# EasyEDA Pro project ProPrj_Avaota A1 八核 AIoT 开发板_2024-05-20.epro, board 点位_TOP (continued)
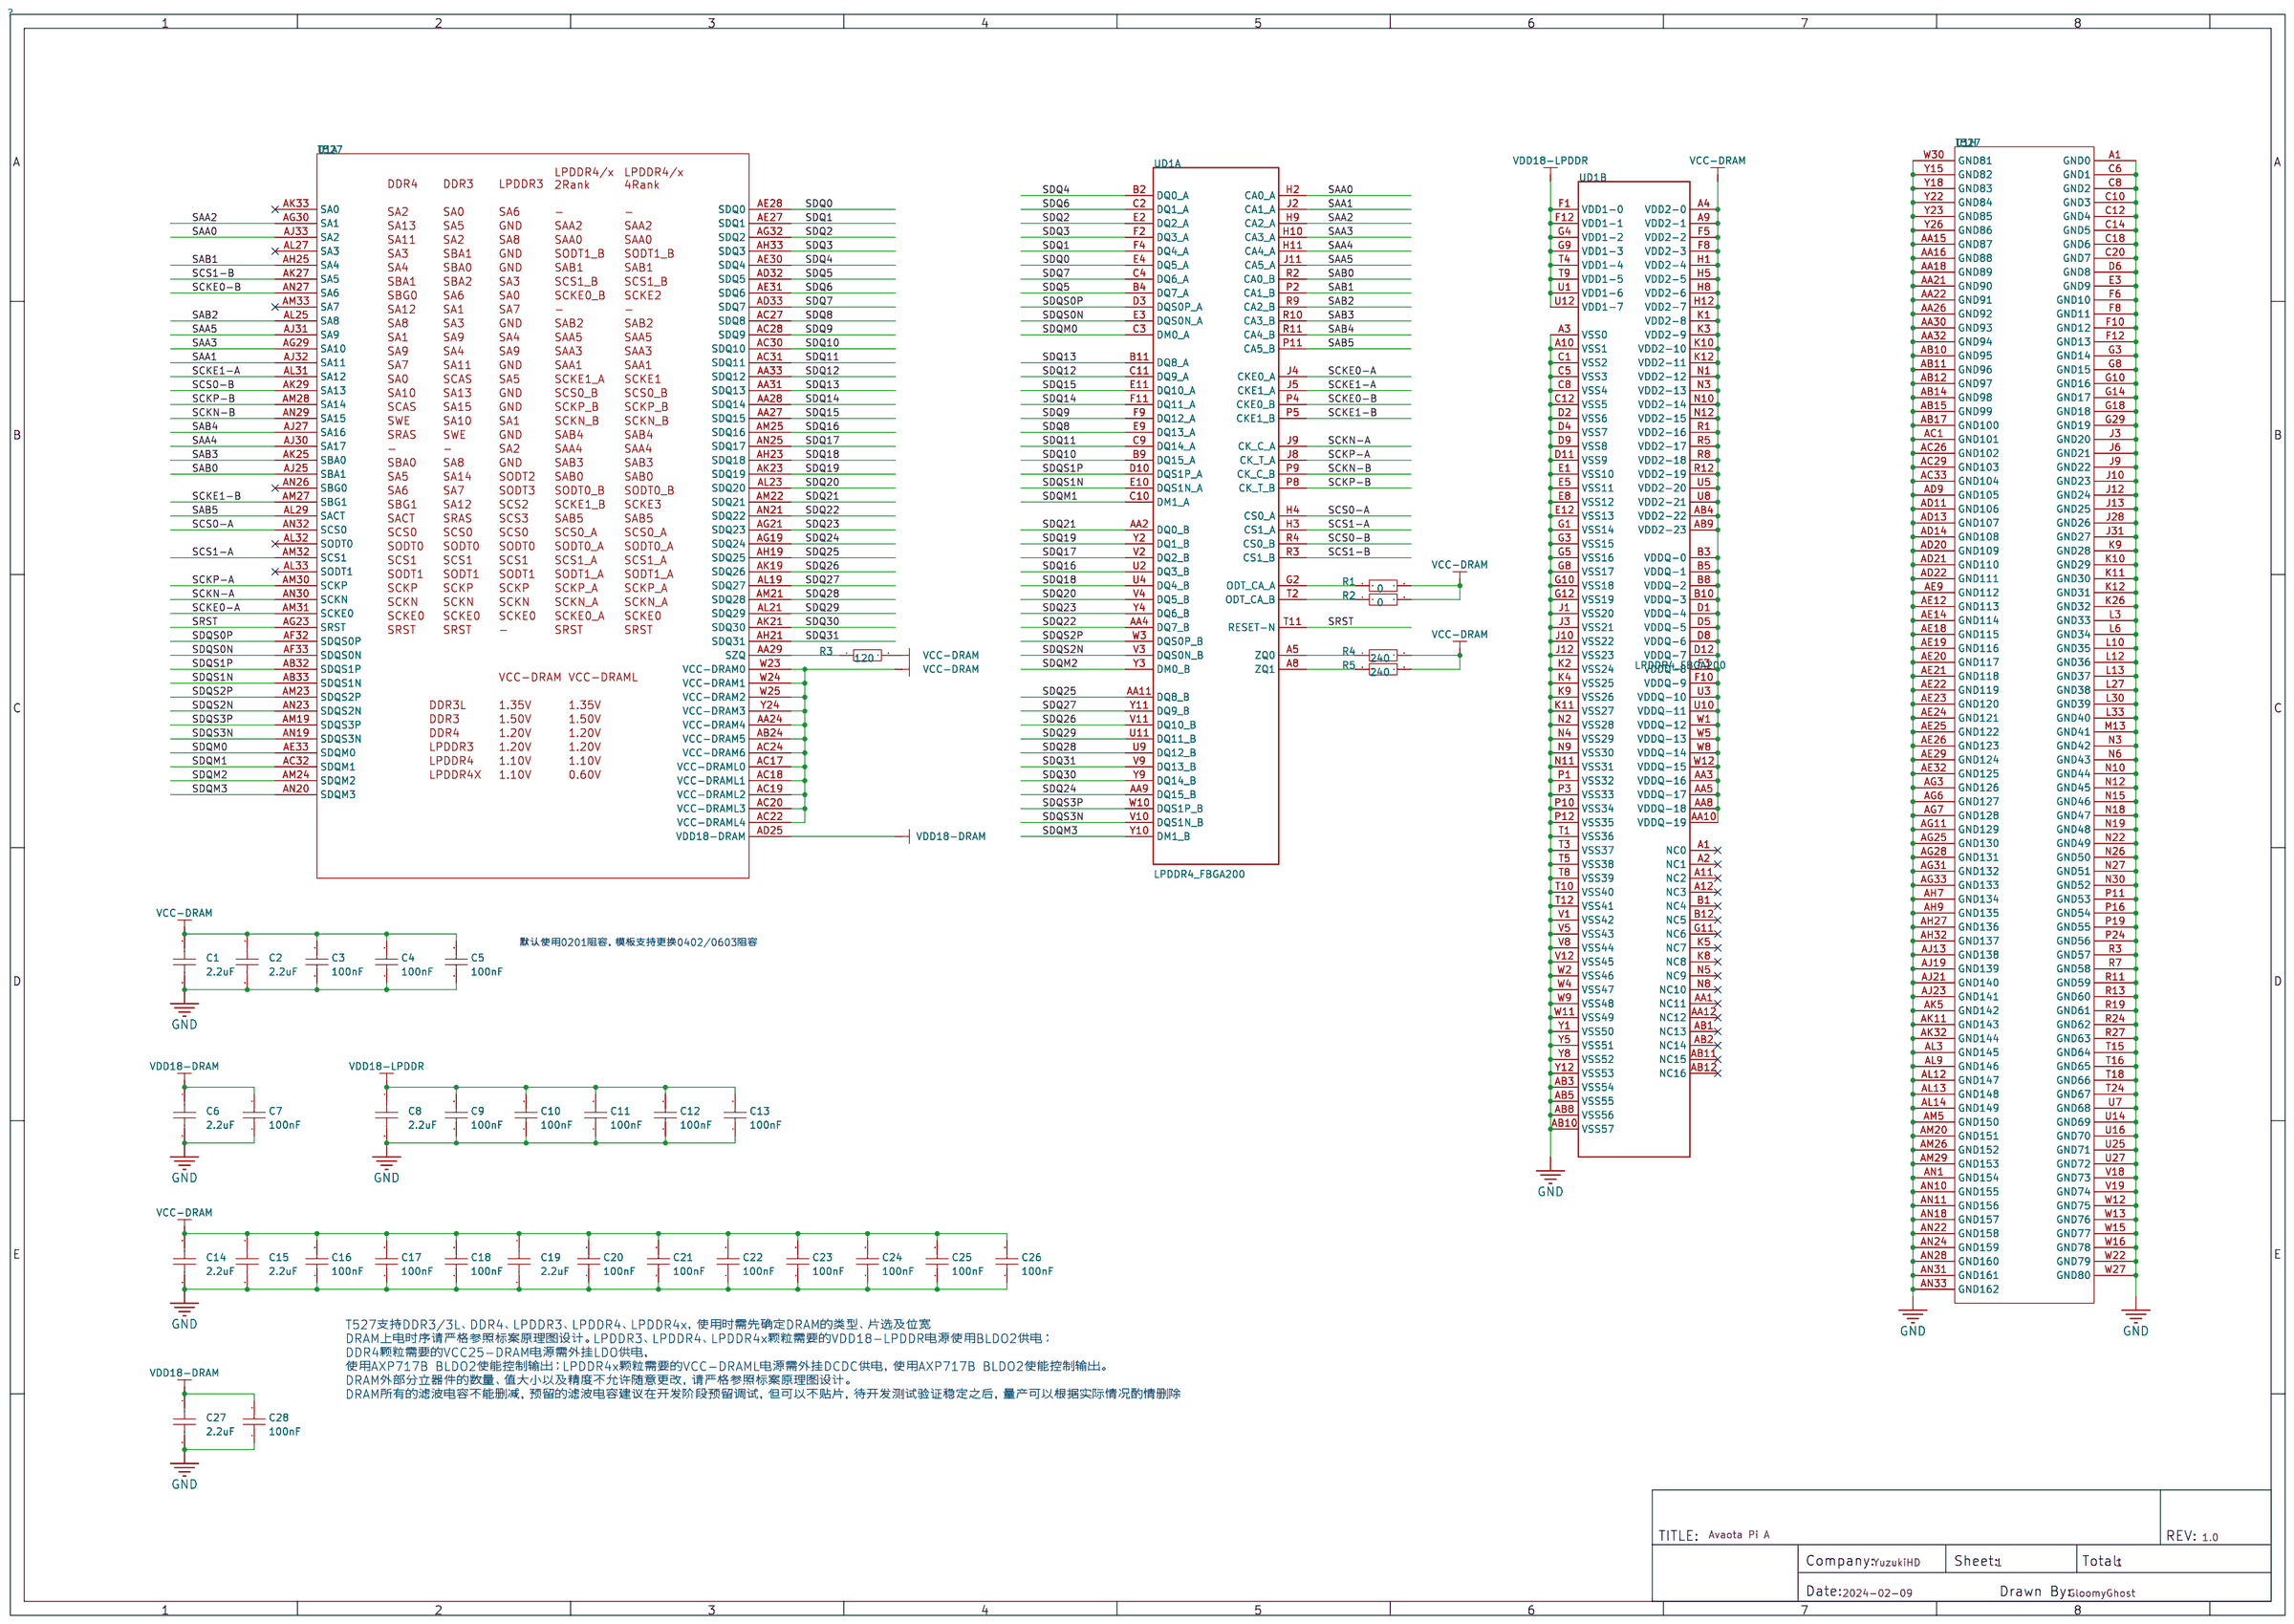
[diagram p0: schematic sheet]
## Nets (continued)
SDC2-RST: U8.K5 U14.Y31
SDQ0: U14.AE28 UD1.E4
SDQ1: U14.AE27 UD1.F4
SDQ2: U14.AG32 UD1.E2
SDQ3: U14.AH33 UD1.F2
SDQ4: U14.AE30 UD1.B2
SDQ5: U14.AD32 UD1.B4
SDQ6: U14.AE31 UD1.C2
SDQ7: U14.AD33 UD1.C4
SDQ8: U14.AC27 UD1.E9
SDQ9: U14.AC28 UD1.F9
SDQ10: U14.AC30 UD1.B9
SDQ11: U14.AC31 UD1.C9
SDQ12: U14.AA33 UD1.C11
SDQ13: U14.AA31 UD1.B11
SDQ14: U14.AA28 UD1.F11
SDQ15: U14.AA27 UD1.E11
SDQ16: U14.AM25 UD1.U2
SDQ17: U14.AN25 UD1.V2
SDQ18: U14.AH23 UD1.U4
SDQ19: U14.AK23 UD1.Y2
SDQ20: U14.AL23 UD1.V4
SDQ21: U14.AM22 UD1.AA2
SDQ22: U14.AN21 UD1.AA4
SDQ23: U14.AG21 UD1.Y4
SDQ24: U14.AG19 UD1.AA9
SDQ25: U14.AH19 UD1.AA11
SDQ26: U14.AK19 UD1.V11
SDQ27: U14.AL19 UD1.Y11
SDQ28: U14.AM21 UD1.U9
SDQ29: U14.AL21 UD1.U11
SDQ30: U14.AK21 UD1.Y9
SDQ31: U14.AH21 UD1.V9
SDQM0: U14.AE33 UD1.C3
SDQM1: U14.AC32 UD1.C10
SDQM2: U14.AM24 UD1.Y3
SDQM3: U14.AN20 UD1.Y10
SDQS0N: U14.AF33 UD1.E3
SDQS0P: U14.AF32 UD1.D3
SDQS1N: U14.AB33 UD1.E10
SDQS1P: U14.AB32 UD1.D10
SDQS2N: U14.AN23 UD1.V3
SDQS2P: U14.AM23 UD1.W3
SDQS3N: U14.AN19 UD1.V10
SDQS3P: U14.AM19 UD1.W10
SPI0-CLK: R123.1
SPI0-CS: U14.K3
SPI0-HOLD: U14.N2
SPI0-MISO: U14.L1
SPI0-MOSI: U14.L2
SPI0-WP: U14.M2
SPI-LCD-BLK: H1.32 U14.AN9
SPI-LCD-CLK: H1.36 TFT1.4 U14.AJ9
SPI-LCD-CS: H1.33 TFT1.7 U14.AK9
SPI-LCD-DC: H1.38 TFT1.5 U14.AJ7
SPI-LCD-MOSI: H1.35 TFT1.3 U14.AK7
SPI-LCD-RST: H1.31 TFT1.6 U14.AM9
SRST: U14.AG23 UD1.T11
STWI1-SCK: H1.28 U14.AM4
STWI1-SDA: H1.29 U14.AM3
UART1-CTS: U9.41 U14.U6
UART1-RTS: U9.44 U14.R4
UART1-RX: U9.42 U14.R5
UART1-TX: U9.43 U14.R6
USB0-DM: D26.2 U14.B24 USB3.A7 USB3.B7
USB0-DP: D25.2 U14.A24 USB3.A6 USB3.B6
USB0-DRVVBUS: R118.2 U14.AL17 U17.4
USB0-VBUSDET: R120.1 R121.2 U14.AK17
USB1-DM: D13.4 D13.7 U14.E24 USB2.2
USB1-DP: D13.5 D13.6 U14.D24 USB2.3
USB2-DM: D14.4 D14.7 U14.E22 USB2.11
USB2-DP: D14.5 D14.6 U14.D22 USB2.12
USB2-RXN: D15.1 D15.10 U14.C23 USB2.14
USB2-RXP: D15.2 D15.9 U14.B23 USB2.15
USB2-TXN: C219.1 U14.B22
USB2-TXP: C220.1 U14.A22
VCM-ADC: U14.Y9
VRA1: U14.AG5
VRA2: U14.AG4
VREFP-ADC: U14.AA9
VRP: U14.AC7
WL-REG-ON: U9.12 U14.U2
WL-WAKE-AP: U9.13 U14.U1
X32KIN: C100.2 R25.1 U14.AM12 X2.1
X32KOUT: C101.2 R25.2 U14.AM11 X2.2
$1N3706: L2.1 U4.10 U4.11
$1N3718: L3.1 U4.33
$1N3723: L4.1 U4.30
$1N3725: C43.1 U4.7
$1N4703: R13.2 U4.39
$1N4773: C44.2 U4.41 U4.42
$1N4806: R14.2 U4.38
$1N4992: L5.2 U4.45 U4.46
$1N6251: L6.1 U5.18
$1N6517: L7.1 U5.19
$1N6728: L8.1 U5.3
$1N7320: C88.1 U5.8
$1N42597: LED1.1 R17.1
$2N1846: R21.1 RESET1.3
$2N2360: R19.1 U14.V3
$2N2431: R20.1 U14.V2
$2N32401: FEL1.3 R22.1
$2N32457: PWR1.3 R23.1
$3N7591: U14.AA29
$3N7643: UD1.A5
$3N7644: UD1.A8
$3N7648: R36.1 UD1.G2
$3N7649: R37.1 UD1.T2
$4N500: R41.2 U14.Y32
$4N609: R42.1 U14.C19
$4N713: R43.1 U14.R1
$5N3909: R123.2 U14.K2
$6N1044: U14.G22
$6N1104: U14.G24
$6N1424: U14.F28
$6N1887: U14.G20
$6N1980: U14.E20
$6N3848: D7.2 R47.2
$6N3980: D8.1 D8.10 R48.2 USB1.13
$6N4130: D9.1 USB1.18
$6N4341: D8.2 D8.9 R50.2 R52.2 USB1.15
$6N4352: D8.4 D8.7 R51.2 R53.2 USB1.16
$6N4414: D8.5 D8.6 R54.2 USB1.19
$6N5317: C190.2 D10.1 D10.10 U15.1
$6N5400: C191.2 D10.2 D10.9 U15.3
$6N5519: C192.2 D10.4 D10.7 U15.4
$6N5561: C193.2 D10.5 D10.6 U15.6
$6N5603: C194.2 D11.1 D11.10 U15.7
$6N5645: C195.2 D11.2 D11.9 U15.9
$6N5687: C196.2 D11.4 D11.7 U15.10
$6N5729: C197.2 D11.5 D11.6 U15.12
$6N6451: C199.2 D12.2 D12.9 R61.2 U15.17
$6N6466: C198.2 D12.1 D12.10 R62.2 U15.15
$6N6553: U15.14
$6N6556: U15.13
$6N19248: C220.2 D15.5 D15.6 USB2.18
$6N19249: C219.2 D15.4 D15.7 USB2.17
$6N30377: R117.1 U17.3
$8N6741: LED2.1 LED3.3
$8N6795: LED3.1 LED4.3
$8N6805: LED4.1 LED5.3
$8N11462: TFT1.12
$10N1043: RJ1.P1
$10N3488: R79.2 RJ1.12
$10N3497: R80.1 RJ1.13
$11N1789: RJ2.P1
$11N1876: R97.2 RJ2.12
$11N1882: R98.1 RJ2.13
$12N612: D2.2 DC1.1 Q1.3
$12N673: Q1.1 R1.1 R2.2
$12N750: C3.2 DC1.5
$12N1163: C4.1 U3.1
$12N1491: C8.2 U3.4
$12N1559: C4.2 D4.2 L1.1 U3.8
$12N1618: C9.1 C10.1 U3.6
$12N1697: C9.2 R7.1
$12N1966: R3.1 R5.2
$12N2016: R5.1 R8.2 U3.5
$12N2052: R4.1 R6.2 U3.3
$12N3300: CN4.2 D1.1
$13N975: C245.2 R72.2 RF1.1
$13N1378: R77.1 R78.1
$13N1478: CN3.1 R77.2
$13N1485: CN3.2 R78.2
$13N5258: CGQ1.4 R125.1

Pads without a net: D12 5 6; D13 1 2 9 10; D14 1 2 9 10; DC1 4; FAN 1 2; FEL1 2 4; LED5 1; PWR1 2 4; RESET1 2 4; TFT1 1 2 9; U4 2 3 4 5 36 40; U5 10; U8 A1 A2 A7 A8 A9 A10 A11 A12 A13 A14 B1 B7 B8 B9 B10 B11 B12 B13 B14 C1 C3 C5 C7 C8 C9 C10 C11 C12 C13 C14 D1 D2 D3 D4 D12 D13 D14 E1 E2 E3 E5 E8 E9 E10 E12 E13 E14 F1 F2 F3 F10 F12 F13 F14 G1 G2 G3 G10 G12 G13 G14 H1 H2 H3 H12 H13 H14 J1 J2 J3 J12 J13 J14 K1 K2 K3 K6 K7 K10 K12 K13 K14 L1 L2 L3 L12 L13 L14 M1 M2 M3 M7 M8 M9 M10 M11 M12 M13 M14 N1 N3 N6 N7 N8 N9 N10 N11 N12 N13 N14 P1 P2 P7 P8 P9 P10 P11 P12 P13 P14; U9 4 5 8 10 11 21 23 24 25 26 27 28 29 30 32 35 37 38 39 40; U14 A5 A8 A16 AA1 AA2 AA3 AA4 AA5 AA6 AB2 AB3 AC2 AC3 AC4 AC5 AC6 AD1 AD2 AE1 AE2 AE4 AE5 AE6 AG1 AG2 AG13 AG17 AH1 AH2 AH11 AH13 AH15 AJ1 AJ15 AK1 AK13 AK15 AK33 AL5 AL7 AL11 AL15 AL27 AL32 AL33 AM6 AM7 AM8 AM14 AM15 AM16 AM17 AM18 AM33 AN4 AN7 AN8 AN15 AN17 AN26 B6 B7 B8 B9 B15 C7 C9 C15 F20 G4 G16 J2 M3 N1 N4 N5 N31 N32 N33 U28 U29 U30 U33 W4 W5 W6 W29 Y2 Y3; UD1 A1 A2 A11 A12 AA1 AA12 AB1 AB2 AB11 AB12 B1 B12 G11 K5 K8 N5 N8; USB2 5 6 8 9

## Via types
v1: diameter 0.399, hole 0.299, Top Layer to Bottom Layer, 335 vias
v2: diameter 0.4, hole 0.299, Top Layer to Bottom Layer, 496 vias
v3: diameter 0.4, hole 0.3, Top Layer to Bottom Layer, 279 vias
v4: diameter 0.61, hole 0.305, Top Layer to Bottom Layer, 5 vias

## Routing (per net, layer and track width the routed paths; a pad name or vN(x,y) marks a point on that pad's centre or on a via; arc(x,y) is an arc through that point)
AGND: length 3.5
  Top Layer w0.152: v2(57.92,55.15) U14.AE3
  Bottom Layer w0.152: 59.14,54.55 59.04,54.65 58.52,54.65 58.52,54.64 57.99,54.64 ; 59.14,54.55 59.14,53.92 ; 59.14,54.55 59.21,54.61 ; 57.99,54.64 57.99,55.08 v2(57.92,55.15) ; 57.99,54.64 57.99,54.08
GND: length 1105.6
  Top Layer w0.076: 52.98,41.81 53.25,41.81 53.33,41.89 53.33,41.89 53.68,41.89 53.93,42.14 ; 68.68,42.41 68.68,42.41 ; 68.68,42.41 68.69,42.16 68.68,41.88 U14.C30 ; 68.68,42.41 U14.C28 ; 68.68,42.41 68.68,42.41 ; v3(49.07,45.47) 49.43,45.8 50.57,45.8 v3(50.8,45.47) ; 56.61,39.42 56.7,39.42 57.18,39.91 57.18,40.28 57.43,40.54 57.43,40.64 ; 65.44,55.14 65.69,55.39 65.69,55.77 65.8,55.88 65.8,56.66 v2(65.94,56.79) ; v2(70.08,49.33) 69.97,49.21 69.22,49.21 69.04,49.39 68.67,49.39 68.45,49.61 ; 56.43,40.14 56.35,40.14 56.19,39.98 56.18,39.98 55.93,39.73 55.12,39.73 54.46,39.06 v3(54.46,39.01) ; 64.45,55.13 64.7,55.38 64.7,55.77 64.87,55.94 64.87,56.35 64.77,56.45 64.77,57.26 64.85,57.33 ; 56.43,40.28 56.68,40.53 56.68,40.89 56.43,41.14 ; U14.A32 69.31,40.65 69.06,40.89 68.69,40.89 U14.C31 ; 64.44,40.14 64.28,39.81 64.23,39.66 64.25,39.32 v2(64.08,38.86) ; 54.51,39.85 54.68,40.03 54.68,40.39 54.93,40.64 ; v1(73.53,53.47) 70.49,53.47 69.91,52.89 68.69,52.89 68.44,52.64 ; 52.55,51.2 52.45,51.3 52.45,51.77 52.65,51.97 52.96,51.97 53.28,51.65 U14.AN10 ; 68.44,43.64 68.69,43.4 69.05,43.4 69.2,43.25 arc(69.25,43.25) 69.29,43.24 arc(69.38,43.22) 69.47,43.22 arc(69.81,43.22) v2(70.16,43.18) ; v3(52.79,42.53) 52.74,42.53 52.73,42.54 51.66,42.54 51.59,42.47 48.99,42.47 46.4,45.06 46.4,45.29 43.86,47.84 43.69,47.82 40.1,47.82 ; 70.59,46.33 70.62,46.36 70.75,46.36 70.89,46.51 v2(71.09,46.51) ; 39.59,47.82 37.51,47.82 v3(37.06,48.41) ; 39.59,47.82 UD1.N4 ; 39.59,47.82 40.1,47.82 ; 69.92,43.23 69.9,43.25 ; v3(52.19,41.81) 52.07,41.68 48.72,41.68 45.64,44.75 45.64,45.06 43.54,47.16 36.65,47.16 36.63,47.18 36.33,47.18 v3(36.17,47.33) ; 36.91,36.04 36.91,35.62 U8.N2 ; UD1.N4 40.1,47.82 ; UD1.N4 v3(40.23,48.43) ; 68.44,47.64 68.69,47.39 69.05,47.39 69.22,47.23 69.84,47.23 70.03,47.41 v2(70.24,47.41) ; 68.69,51.39 69.64,51.39 69.82,51.58 ; 68.69,51.39 68.44,51.64 ; 68.69,51.39 68.69,51.39 68.69,50.89 U14.C12 ; 71.05,44.25 72.29,44.25 v1(72.31,44.22) ; 53.93,46.64 53.68,46.89 53.07,46.89 ; 62.2,57.01 62.2,56.85 v2(62.2,56.85) 62.23,56.37 62.2,56.13 62.2,56.07 62.21,55.9 62.19,55.7 62.19,55.42 62.43,55.18 ; 68.44,52.64 68.69,52.39 68.69,51.9 U14.C10 ; 68.44,52.64 U14.C8 ; v3(59.9,41.59) 59.69,41.28 59.68,40.93 59.44,40.65 ; 63.4,56.72 63.2,56.52 63.2,55.38 63.44,55.14 ; 53.01,43.39 53.68,43.39 53.93,43.64 ; 71.04,44.23 arc(70.87,44.22) 70.7,44.23 arc(70.67,44.24) 70.64,44.24 70.36,44.24 arc(70.22,44.24) 70.09,44.24 69.22,44.24 69.07,44.39 arc(69.04,44.39) 69,44.39 arc(68.72,44.46) 68.47,44.62
  Top Layer w0.102: 61.49,22.4 61.73,22.64 C252.1 62.67,22.64 v2(62.76,22.56) ; v3(48.36,47.8) 49.91,47.8 49.98,47.73 51.74,47.73 ; v2(66.95,55.14) 67.44,55.14 ; C101.1 51.23,55.16 51.23,54.22 51.26,54.2 51.54,54.2 52.04,53.69 52.04,51.48 52.32,51.2 52.55,51.2 52.65,51.1 53.4,51.1 U14.AN11 ; v2(44.75,19.63) 44.58,19.81 D6.8 D6.3 v2(44.58,21.79) ; 51.36,52.3 51.35,52.31 C100.1 ; 51.36,52.3 arc(51.36,51.77) 51.36,51.25 ; 51.36,52.3 arc(51.36,52.39) 51.36,52.48 arc(51.36,52.91) 51.36,53.34 ; R33.1 R35.1 v2(57.56,59.79) ; v3(56.07,39) 56.07,39.05 56.44,39.42 56.61,39.42 ; X1.4 50.53,51.02 C99.1 51.36,51.25 ; v3(52.91,44.78) 52.8,44.78 52.4,44.38 51.45,44.38 51.36,44.29 51.33,44.29 ; 66.95,55.15 U14.G3 ; 51.36,51.25 51.64,50.97 v2(51.64,50.72) ; R34.1 v2(59.23,59.82) ; v2(47.45,21.79) D5.3 ; v1(36.91,36.6) 36.91,36.04 ; 56.43,40.28 56.43,40.14 ; v2(47.45,19.76) D5.8
  Top Layer w0.115: v3(50.8,45.47) 50.8,45.44 51.2,45.03 52.07,45.03 52.63,45.59 53.38,45.59 ; 53.38,45.59 53.39,45.59 U14.AN22 ; 53.38,45.59 53.43,45.64
  Top Layer w0.127: 53.01,43.39 53,43.38 52.24,43.38 v3(52.09,43.23) ; 64.85,57.33 v2(64.99,57.47) ; 50.14,23.88 D12.3 v2(50.14,22.33) ; v2(51.46,24.56) 51.37,24.56 R60.1 51.22,24.8 ; v3(48.36,47.8) 48.33,47.8 48.16,47.62 48.16,46.86 48.49,46.53 48.94,46.53 49.06,46.65 v3(49.6,46.65) ; 35.81,33.63 35.23,34.21 35.23,35.87 v1(34.44,36.65) ; 35.81,33.63 35.81,34.03 U8.P4 ; 35.81,33.63 36.06,33.39 U8.P6 U8.N5 ; v3(36.23,50.43) 36.18,50.38 35.41,50.38 v3(35.38,50.42) ; 34.41,44.51 33.81,44.51 ; D15.8 D15.3 ; D13.8 D13.3 ; 41.41,46.15 41.71,46.46 43.13,46.46 44.88,44.7 44.88,44.48 48.46,40.89 52.74,40.89 ; v3(40.21,49.61) 40.11,49.71 39.35,49.71 ; v2(85.78,17.68) C272.2 ; 35.81,48.1 35.81,47.7 ; U14.C31 U14.C30 ; 52.98,41.81 52.27,41.81 52.26,41.81 v3(52.19,41.81) ; 33.92,49.72 34.58,49.72 v3(34.59,49.71) ; v2(65.58,17.7) C267.2 ; v2(83.79,17.68) C275.1 ; D8.3 D8.8 ; C266.2 v2(67.61,17.7) ; D11.8 D11.3 ; D10.8 D10.3
  Top Layer w0.152: C101.1 50.91,55.72 50.22,56.41 ; 78.33,48.95 79.07,48.21 81.59,48.21 81.79,48.41 81.79,48.9 81.59,49.1 v1(80.85,49.1) ; v3(53.34,39.03) 53.35,39.03 53.35,39.07 54.14,39.85 54.51,39.85 ; U5.9 14.52,42.61 14.25,42.34 13.97,42.34 13.72,42.6 13.72,44.2 13.98,44.46 C73.2 ; 76.25,7.14 v2(76.25,7.24) ; 76.25,7.14 R112.1 ; 76.25,7.14 76.25,7.12 R114.1 ; C35.1 14.01,55.07 C64.1 ; v1(78.33,23.01) 79.1,23.01 79.96,22.15 80.25,22.15 80.49,22.39 C259.1 ; U14.R13 62.83,49.76 63.56,49.76 U14.M13 ; U8.C4 41.29,34.01 41.1,34.01 40.82,34.29 40.07,34.29 U8.G5 ; C95.1 6.82,47.37 v2(7.29,47.37) ; C64.1 C66.1 ; C64.1 C12.2 C62.1 C60.1 C65.2 C63.2 C17.2 C61.2 C59.2 C54.2 C53.2 C55.2 C52.2 C51.2 v1(14.99,47.83) ; U14.Y22 U14.AA22 U14.AA21 ; U14.Y22 U14.Y23 ; U14.Y22 U14.W22 ; R104.1 R100.1 ; 35.28,41.94 35.15,41.91 v3(34.52,41.94) ; 56.87,42.22 U14.AE29 v3(57.91,42.42) ; 56.87,42.22 v3(56.94,41.66) U14.AG31 ; 56.87,42.22 U14.AG28 ; 8.47,47.41 8.46,47.42 ; 8.47,47.41 v2(8.47,47.04) ; 8.47,47.41 C43.2 ; U14.AN18 52.56,47.65 51.97,48.23 48.79,48.23 v3(48.36,47.8) ; v1(49.38,26.26) 48.92,26.26 48.56,25.91 R62.1 ; 60.43,41.64 59.96,41.64 v3(59.9,41.59) ; C258.2 C256.2 84.24,27.13 R111.1 R113.1 ; U14.AA7 59.43,53.14 v1(58.98,53.14) ; C69.2 17.7,41.15 v1(17.53,41.33) ; 53.41,41.12 53.16,41.12 ; TFT1.8 90.1,44.31 90.4,44.6 90.4,45.8 v1(90.02,46.18) ; U14.C20 U14.C21 U14.B21 69.64,46.15 69.82,46.33 70.59,46.33 ; v3(36.17,47.33) 35.81,47.7 ; U13.41 84.76,22.3 86.92,24.46 86.92,25.2 88.06,26.34 88.06,26.87 87.82,27.11 C274.2 ; U14.A33 69.61,40.15 v2(69.85,40.39) 69.59,40.65 U14.A32 ; U14.F12 66.88,50.65 66.42,51.11 v1(66.42,51.13) ; v3(49.07,45.47) 49.07,45.19 49.97,44.29 51.33,44.29 ; 53.07,46.89 52.86,46.89 52.58,46.61 52.04,46.61 51.76,46.89 49.84,46.89 v3(49.6,46.65) ; 41.41,46.15 41.09,46.46 40.24,46.46 40.16,46.38 40.07,46.46 39.6,46.46 v3(39.44,46.3) 39.28,46.46 38.36,46.46 37.87,45.97 v3(37.59,45.97) ; v1(14.99,47) C16.1 C15.1 ; U14.T18 U14.R19 ; 43.46,33.25 43.32,33.39 U8.A6 ; U14.T15 U14.T16
  Top Layer w0.178: v1(83.24,27.58) C258.2
  Top Layer w0.203: U14.AB12 U14.AB11 U14.AB10 U14.Y10 ; U14.AE14 U14.AD14 U14.AD13 ; 42.27,45.5 42.35,45.5 42.47,45.38 43.04,45.38 43.15,45.49 43.2,45.49 v3(43.2,45.5) ; 53.43,42.64 52.93,42.64 ; 71.05,44.25 71.08,44.22 v1(72.31,44.22) ; 63.4,56.72 63.4,57.38 v2(63.55,57.53) ; U5.9 v2(15.85,42.61) v2(16.25,43.01) ; C45.1 v1(5.31,56.85) ; 35.28,41.94 35.59,42.25 35.81,42.25 ; v2(9.44,48.32) 9.35,48.41 9.17,48.41 9.06,48.52 U4.8 ; 36.61,44.2 37.21,44.2 v3(37.74,44.73) ; 36.61,41.6 36.68,41.53 37.51,41.53 v3(37.72,41.33) ; 53.43,40.14 53.43,40.13 53.42,40.12 53.42,39.96 52.69,39.23 52.69,39.05 v3(52.67,39.03) ; 42.21,48.75 42.43,48.97 44.13,48.97 v3(44.36,48.74) ; 53.16,41.12 52.93,40.89 52.74,40.89 ; C291.1 3.54,57.11 R13.1 ; 68.42,46.16 68.44,46.14 68.44,45.63
  Top Layer w0.254: U14.N19 U14.M19 ; U14.N19 U14.N18 63.44,48.56 63.35,48.65 ; U14.N19 U14.P19 U14.R19 ; U14.M19 U14.L19 ; U14.M19 U14.M18 ; 56.12,43.14 56.43,42.83 56.43,42.64 ; 56.12,43.14 55.93,43.14 ; 56.12,43.14 56.59,43.61 v3(56.59,43.67) 56.59,44 U14.AG25 ; v3(53.34,39.03) 53.34,39.02 53.34,38.74 53.52,38.56 54.73,38.56 ; U14.V19 U14.V18 60.94,48.15 ; 54.73,38.56 54.46,38.84 v3(54.46,39.01) ; 54.73,38.56 55.8,38.56 ; 63.35,48.65 v1(62.94,48.65) U14.N15 ; 63.35,48.65 U14.M16 U14.L16 U14.K16 ; v1(57.45,52.65) 57.45,52.16 U14.AE9 ; v3(40.21,45.85) 40.55,45.5 40.61,45.5 ; U14.AB11 U14.AD11 57.94,51.65 U14.AE9 ; 41.41,46.15 41.52,46.03 41.7,46.03 v3(41.73,46) ; 33.81,44.51 33.77,44.47 ; 33.77,44.47 33.5,44.2 33,44.2 v3(32.93,44.26) 32.86,44.34 32.23,44.34 ; 33.77,44.47 v3(33.81,44.47) ; 67.96,27.24 68.55,27.24 ; 33.41,52.65 33.75,52.3 v3(33.81,52.3) 34.12,52 34.21,52 ; 69.92,43.23 70.11,43.23 v2(70.16,43.18) ; 58.44,56.14 58.44,56.48 58.29,56.63 ; v2(70.24,47.41) 70.25,47.42 ; v3(37.09,51.3) 37.06,51.3 37.06,51.31 37.01,51.31 36.97,51.35 36.61,51.35 ; U14.F24 U14.F22 v2(66.94,46.13) ; v1(55.94,52.15) 55.94,52.62 55.93,52.63 55.94,52.64 U14.AH7 U14.AG7 U14.AG6 ; U14.AA15 U14.AB15 U14.AB14 ; U14.AA15 U14.AA16 U14.AB17 ; U14.AA15 U14.Y15 U14.W15 ; U14.G18 65.94,48.15 U14.J17 U14.K16 ; v3(42.72,51.32) 42.71,51.32 42.7,51.33 42.59,51.33 42.57,51.35 42.21,51.35 ; 36.61,50.05 v3(36.23,50.43) ; 56.92,55.15 U14.AG3 ; U14.G28 U14.G29 66.92,42.15 v2(66.93,42.14) 67.44,42.14 U14.E29 ; U14.N27 U14.N26 ; U14.N27 U14.L27 64.79,43.15 64.97,43.33 64.97,43.61 U14.K26 U14.K25 ; U14.N27 U14.R27 ; 40.61,53.95 40.61,54.32 v3(40.84,54.56) ; v2(62.94,53.09) 62.88,53.15 U14.R7 v2(61.95,53.15) U14.U7 ; U14.W13 U14.W12 60.44,50.9 59.94,51.4 U14.Y10 ; v3(42.85,43.84) 42.49,44.2 42.21,44.2 ; v3(35.25,54.41) 35.25,54.2 35.01,53.95 ; 52.93,42.64 52.89,42.6 52.89,42.6 52.82,42.53 v3(52.79,42.53) ; v3(37.16,42.87) 37.13,42.9 36.61,42.9 ; U14.K16 U14.K15 ; 59.43,41.64 59.49,41.59 v3(59.9,41.59) ; 69.82,51.58 v2(70.35,51.58) ; 36.61,53.95 36.61,54.32 36.55,54.38 v3(36.47,54.38) ; 36.61,52.65 36.52,52.65 v3(36.22,52.35) 35.87,52 35.81,52 ; C149.1 C148.1 32.5,46.04 32.99,46.53 33.6,46.53 v3(33.78,46.71) ; 60.94,48.15 U14.W16 ; 60.94,48.14 v1(61.44,48.65) ; 60.43,43.14 60.5,43.21 60.5,43.38 60.24,43.64 58.43,43.64 ; U14.J6 U14.L6 v2(63.93,53.65) ; 33.41,51.35 33.01,51.35 v3(32.74,51.62) ; 55.8,38.56 58.04,38.56 58.16,38.68 v3(58.16,38.96) 58.06,39.06 58.06,39.77 58.43,40.14 ; 55.8,38.56 56.07,38.82 v3(56.07,39) ; C265.2 61.06,20.29 60.48,20.88 ; v3(33.78,46.71) 33.78,47.6 v3(33.83,47.65) 33.83,47.72 34.21,48.1 v3(33.87,48.44) 33.72,48.44 32.94,49.22 32.94,49.46 32.76,49.63 v3(32.76,49.71) 33.09,49.71 33.41,50.02 33.41,50.05 33.74,49.72 v3(33.74,49.71) ; v3(33.78,46.71) 33.78,45.92 v3(33.77,45.91) ; U14.F8 66.93,52.63 v1(66.93,52.12) 66.94,52.11 U14.F10 U14.G10 ; U14.F8 U14.G8 66.43,52.63 v1(65.91,52.63) ; U14.F8 66.95,52.66 v2(66.95,53.14) 66.95,53.63 U14.F6 ; U14.AE14 57.02,50.06 57.02,50.37 57.3,50.65 U14.AE12 56.94,51.15 U14.AG11 U14.AJ13 v2(55.44,49.68) ; v3(39.44,46.3) 39.65,46.3 39.81,46.15 ; U14.A1 69.67,56.38 v2(69.67,56.41) ; U14.K10 U14.J10 ; U14.K10 U14.L10 ; U14.K10 U14.K11 U14.K12 ; U14.K10 U14.K9 ; U14.J10 U14.G10 ; U14.J10 65.44,51.1 ; U14.J10 U14.J9 65.44,52.62 v1(65.43,52.63) ; v3(37.36,54.08) 38.88,54.08 39.01,53.95 ; 41.41,48.1 41.49,48.1 v3(41.68,48.29) ; U14.AE9 U14.AD9 ; v2(57.44,45.64) U14.AD22 ; v2(57.44,45.64) v2(57.44,45.15) v2(57.44,44.65) v2(57.44,44.15) U14.AE26 ; v2(57.44,45.64) v2(57.44,46.15) ; 58.43,42.14 58.19,42.14 v3(57.91,42.42) ; U14.P11 63.21,51.15 63.44,50.91 U14.N12 U14.M13 U14.L13 U14.L12 U14.K12 ; U14.P11 U14.N10 ; U14.P11 U14.R11 ; U14.G10 66.44,51.15 v1(66.42,51.13) 66.39,51.1 65.44,51.1 ; U14.N6 63.93,53.65 ; v3(33.77,45.91) 33.77,45.87 33.41,45.5 ; v3(33.77,45.91) 33.78,45.91 33.79,45.92 33.83,45.92 34.05,46.15 34.21,46.15 ; v3(38.22,50.72) 38.22,50.74 38.49,51 38.75,51 39.01,51.26 39.01,51.35 ; 39.81,52 40.18,51.62 40.18,50.98 v3(40.21,50.95) 40.2,50.95 40.2,50.45 40.61,50.05 40.21,49.65 40.21,49.61 v3(40.21,49.61) 40.18,49.58 40.18,49.17 40.6,48.75 ; U14.J28 U14.J26 ; 33.92,49.72 33.74,49.72 ; U14.AN1 53.25,56.34 v2(53.11,56.34) ; 39.01,41.6 38.73,41.33 v3(38.56,41.33) ; v3(42.65,52.43) 42.44,52.65 42.1,52.65 41.85,52.4 v3(41.78,52.4) 41.78,52.37 41.41,52 ; v2(57.44,46.15) U14.AD21 ; v2(57.44,46.15) v2(57.44,46.64) ; U14.N30 v2(63.95,41.65) U14.L30 64.94,41.65 U14.J31 ; 35.43,50.47 v3(35.38,50.42) 34.67,49.72 34.6,49.72 v3(34.59,49.71) 34.59,49.28 35.01,48.86 35.01,48.75 35.25,48.75 35.81,48.19 35.81,48.1 ; 32.23,42.46 32.23,43.14 32.6,42.77 v3(32.81,42.77) 32.94,42.9 33.41,42.9 ; v3(32.99,41.27) 33.08,41.27 33.65,41.84 33.74,41.84 v3(33.78,41.88) 33.84,41.88 34.21,42.25 ; v1(61.44,48.65) U14.T16 ; v1(61.44,48.65) 61.44,49.52 61.39,49.57 ; 56.43,40.14 55.93,40.64 ; v3(40.44,39.85) 40.49,39.89 40.49,40.18 40.61,40.3 ; 55.43,47.14 55.49,47.08 v3(55.49,46.69) 55.43,46.63 55.43,46.14 55.5,46.08 v3(55.5,45.66) 55.43,45.59 55.43,44.77 v3(55.5,44.7) ; v3(38.4,53.26) 38.4,53.25 39.01,52.65 ; U14.N22 63.44,45.59 62.94,45.09 U14.P24 U14.R24 U14.T24 U14.U25 v1(60.99,44.15) 60.99,43.46 61.3,43.15 U14.U27 ; 39.01,42.9 38.65,43.26 38.38,43.26 37.89,43.74 v3(37.82,43.74) ; 39.01,33.55 39.08,33.48 39.26,33.48 U8.G5 ; 39.01,33.55 39.01,33.49 v1(38.73,33.22) 38.73,32.95 U8.K8 38.17,32.38 37.79,32 37.79,31.19 38.02,30.96 38.74,30.96 U8.H10 U8.E7 ; 39.01,33.55 38.67,33.89 ; 40.61,44.2 40.53,44.2 40.23,44.5 v3(40.23,44.53) ; 65.44,51.1 U14.J12 ; v2(57.44,46.64) U14.AD20 ; v2(57.44,46.64) v2(57.44,47.15) v2(57.44,47.64) ; U14.K12 U14.J12 ; U14.J12 U14.J13 ; U14.AK5 v1(54.44,54.65) ; v1(54.44,54.65) U14.AM5 ; v1(54.44,54.65) U14.AL3 ; 66.75,27.24 66.71,27.28 C249.2 C250.2 65.18,27.33 65.18,27.69 64.92,27.94 62.08,27.94 C254.2 61.33,27.48 61.14,27.29 61.14,25.96 61.39,25.71 61.59,25.71 C253.2 ; R7.2 10.62,40.21 10.9,40.49 12.8,40.49 13.38,39.91 R8.1 ; U14.L24 U14.K25 ; U14.K25 U14.K24 U14.H24 ; v2(55.88,22.38) 55.88,22.98 D10.8 ; U14.D6 U14.C6 68.44,54.14 v2(68.45,54.15) ; 41.41,42.25 41.56,42.25 41.81,41.99 41.81,41.99 v3(41.82,41.98) 41.82,41.98 42.21,41.6 42.74,41.6 43.05,41.91 v3(43.05,41.93) ; 39.81,42.25 40.18,41.87 v3(40.18,41.33) ; v1(42.01,19.61) 41.71,19.91 D8.3 ; 32.23,40.09 32.23,40.65 ; v3(35.33,43.92) 35.05,44.2 35.01,44.2 34.73,44.48 v3(34.59,44.48) 34.56,44.51 34.41,44.51 ; v3(42.8,50.24) 42.6,50.05 42.21,50.05 ; 35.01,40.3 34.96,40.3 v3(34.63,40.62) ; 53.43,44.64 53.41,44.66 53.02,44.66 v3(52.91,44.78) ; v3(32.76,48.67) 32.5,48.4 C158.1 ; 10.62,39.98 C10.2 ; v3(38.66,49.88) 38.84,49.88 39.01,50.05 39.35,49.71 ; 39.01,44.2 38.58,44.2 v3(38.45,44.32) ; 42.21,42.9 42.43,42.9 v3(42.58,43.05) ; v2(54.44,49.65) U14.AL13 U14.AL12 U14.AK11 54.94,51.15 v1(54.43,51.66) 54.44,51.67 U14.AL9 ; 35.81,46.15 35.53,45.87 35.38,45.87 v3(35.35,45.85) 35.01,45.5 ; U14.J21 U14.K21 U14.K22 U14.J22 U14.J23
  Top Layer w0.508: USB3.13 81.51,69.46 USB3.B1A12 ; USB3.12 89.05,68.55 USB3.A1B12 ; CN4.1 17.69,29.33 R6.1
  GND1 w0.076: 35.63,42.21 35.53,42.21 35.51,42.24 35.25,42.24 35.22,42.21 35.18,42.21 ; 34.41,50.65 34.47,50.6 34.77,50.6 34.82,50.65
  内层2 w0.152: v1(53.01,26.29) 58.45,31.72 67.26,31.72 68,32.46 68,33.96 71.52,37.48 71.8,37.48 v1(71.91,37.59) ; v1(73,30.89) 73,30.61 72.36,29.97 59.36,29.97 55.98,26.59 55.98,26.3 55.94,26.26 v1(55.88,26.26) ; v1(74.78,37.16) 74.24,36.63 71.73,36.63 68.83,33.73 68.83,32.06 67.67,30.89 58.79,30.89 54.44,26.54 v1(54.44,26.26)
  内层4 w0.152: v2(75.87,43.13) 76.94,43.13 78.87,41.2 78.87,29.62 76.28,27.03 70.89,27.03 69.24,28.68 60.73,28.68 59.46,27.41 48.87,27.41 47.83,26.37 47.83,22.91 47.45,22.53 v2(47.45,21.79) ; v1(45.97,21.9) 45.97,22.89 46.96,23.88 46.96,26.75 48.41,28.19 59.03,28.19 60.5,29.67 69.34,29.67 71.2,27.81 75.87,27.81 78.03,29.97 78.03,40.69 76.58,42.14 75.72,42.14 v2(75.69,42.16) ; v2(44.58,21.79) 44.58,22.83 46.08,24.33 46.08,27.03 48.08,29.03 58.34,29.03 59.84,30.53 69.75,30.53 71.6,28.68 75.34,28.68 77.22,30.56 77.22,39.98 76.1,41.1 v2(75.82,41.1)
  Bottom Layer w0.102: 10.77,49.43 10.21,50.01
  Bottom Layer w0.152: 61.39,49.57 61.85,49.11 61.85,49.05 v1(61.44,48.65) 61.44,47.6 61.37,47.52 62.43,47.52 62.46,47.55 63.38,47.55 ; 63.38,47.55 63.49,47.55 ; 63.38,47.55 63.41,47.58 63.41,48.64 ; 61.97,51.71 65.12,51.71 65.21,51.61 65.21,52.15 ; v2(66.94,46.13) 66.94,45.71 66.92,45.68 66.92,44.65 ; 60.26,52.65 60.26,52.79 60.07,52.98 59.13,52.98 v1(58.98,53.14) ; 89.41,46.9 89.41,48.46 88.9,48.97 88.11,48.97 87.77,48.63 87.77,47.76 ; 27.36,19.53 27.25,19.43 27.25,17.55 v1(27.43,17.37) ; 65.95,43.47 65.95,44.12 ; v2(61.95,53.15) 62.06,53.15 62.33,53.42 62.33,55.73 62.08,55.98 61.89,55.98 ; 51.24,58.88 51.25,58.87 51.25,57.64 52.55,56.34 v2(53.11,56.34) ; 41.83,32.41 41.85,32.42 41.85,32.89
  Bottom Layer w0.203: v2(76.25,7.24) 76.25,7.42 75.77,7.9 75.77,8.92 75.2,9.49 ; v1(9.75,50.06) 10.16,50.06 10.21,50.01 ; v3(33.87,48.44) 34.1,48.21 34.1,47.92 v3(33.83,47.65) ; v3(40.23,48.43) 40.32,48.34 40.32,47.9 ; 90.5,18.8 89.38,17.68 v2(85.78,17.68) v2(83.79,17.68)
  Bottom Layer w0.254: 34.16,44.22 v3(34.59,44.48) ; 60.99,44.56 61.95,44.56 61.95,44.55 62.51,44.55 ; 60.99,44.56 v1(60.99,44.15) ; 60.99,44.56 60.99,45.03 60.96,45.06 ; 57.54,52.15 57.54,52.57 v1(57.45,52.65) 58.32,52.65 ; 55.22,54.69 55.17,54.65 v1(54.44,54.65) 54.31,54.78 53.77,54.78 53.43,55.12 ; 60.89,48.28 60.86,48.31 58.9,48.31 ; 36.1,42.06 35.58,42.06 35.33,41.81 34.64,41.81 v3(34.52,41.94) ; 64.4,46.03 64.4,45.54 64.94,45.54 ; 33.29,40.66 33.29,40.97 v3(32.99,41.27) ; v3(40.44,39.85) 40.54,39.75 40.54,39.3 40.51,39.27 ; 57.91,42.74 v3(57.91,42.42) ; 57.91,42.74 57.91,43.06 57.94,43.09 ; 57.91,42.74 57.97,42.8 58.34,42.8 58.42,42.87 58.42,43.65 58.95,43.65 ; 35.42,44.4 35.42,44.01 v3(35.33,43.92) ; 94.59,39.46 93.74,39.46 93.52,39.68 84.48,39.68 83.62,40.54 83.62,49.48 v1(80.52,52.58) 79.63,53.47 v1(73.53,53.47) ; 43.2,43.2 42.73,43.2 v3(42.58,43.05) ; 38.82,32.74 38.82,33.13 v1(38.73,33.22) ; 64.94,45.54 65.44,45.54 65.46,45.56 ; 64.94,45.54 64.99,45.49 64.99,45.03 ; 64.94,45.54 64.92,45.56 ; 58.32,52.65 58.41,52.65 ; 58.32,52.65 57.94,53.04 57.94,53.48 58,53.54 ; 94.59,33.46 85.49,33.46 83.9,35.05 83.9,38.25 82.55,39.6 82.55,45.57 v1(82.58,45.59) 82.58,49.12 v1(80.62,51.08) 79.22,52.48 v1(72.54,52.48) ; v2(97.71,60.22) 98.5,61.01 98.81,61.01 ; v1(61.44,48.65) 61.2,48.89 58.62,48.89 58.3,49.21 57.89,49.21 57.88,49.2 56.81,49.2 56.81,50.23 56.76,50.28 56.76,50.27 56.23,50.27 ; 94.59,40.46 85.55,40.46 84.51,41.5 84.51,49.63 79.93,54.2 75.26,54.2 74.52,54.94 v1(74.52,55.12) ; 51.61,43.79 51.66,43.79 51.81,43.63 ; v3(35.35,45.85) 35.61,45.85 36.02,46.26 36.07,46.26 ; 64.53,51.13 65.18,51.13 65.2,51.11 65.2,50.6 ; 59.94,43.65 60.28,43.65 60.5,43.43 60.5,43.21 v3(60.45,43.15) ; v1(80.85,49.1) 80.85,49.02 80.62,48.79 80.62,46.08 v1(81.1,45.59) 81.1,39.24 82.78,37.57 82.78,34.06 84.88,31.96 94.59,31.96 ; v2(72.11,35.03) 71.22,35.03 66.88,30.68 47.5,30.68 44.27,27.46 35.28,27.46 27.36,19.53 ; v3(35.25,54.41) 35.11,54.27 34.75,54.27 ; v1(75.9,33.91) 76.89,32.92 76.89,31.32 75.49,29.92 48.18,29.92 44.55,26.29 35.79,26.29 28.7,19.2 28.7,18.9 ; 40.03,50.32 40.03,50.78 v3(40.21,50.95) ; v3(40.84,54.56) 40.56,54.28 39.52,54.28 ; 65.2,50.6 64.53,50.6 ; 65.2,50.6 65.2,50.11 ; 42.38,43.87 42.4,43.84 v3(42.85,43.84) 43.23,44.22 43.33,44.22 ; 37.99,44.22 38.35,44.22 v3(38.45,44.32) ; 63.41,49.15 63.41,49.11 v1(62.94,48.65) 63.41,48.65 63.41,48.64 ; 6.5,54.81 4,54.81 3.99,54.82 ; v1(30.18,18.9) 36.63,25.35 45.09,25.35 48.74,29.01 76.1,29.01 78.89,31.8 78.89,36.55 76.33,39.12 74.7,39.12 73.18,40.64 73.18,43.36 v1(72.31,44.22) ; 52.58,43.87 52.55,43.84 51.81,43.84 51.81,43.63 ; 60.12,54.61 59.72,55.02 59.72,55.68 60.03,55.99 60.15,55.99 ; v1(59.44,45.14) 59.44,46.51 59.59,46.66 ; v3(38.66,49.88) 38.66,49.78 38.22,49.34 ; v3(52.09,43.23) 51.81,43.51 51.81,43.63 ; 63.32,43.57 63.22,43.57 63.04,43.76 62.68,43.76 62.66,43.78 62.55,43.66 62.04,43.66 62.04,42.6 ; 66.34,49.61 66.34,48.49 ; v3(36.23,50.43) 36.09,50.57 36.09,50.99 ; 4.78,51.05 4.78,51.94 4.77,51.94 3.78,51.94 ; 39.88,45.46 39.88,45.52 v3(40.21,45.85) ; 38.21,43.26 37.82,43.65 v3(37.82,43.74) ; 40.37,41.91 40.37,41.52 v3(40.18,41.33) ; 56.44,55.03 56.48,55.03 56.59,55.14 v1(56.92,55.14) ; v2(67.61,17.7) v2(65.58,17.7) 61.59,17.7 v2(61.06,18.24) ; 42.57,51.84 42.57,51.47 v3(42.72,51.32) ; 53.89,51.66 v1(54.43,51.66)